# EasyEDA Pro project URADORRY-SUN1.2.eprj, schematic Main(1.2)

## Sheets
1 base: Create Date: 2024-06-10; Page Name: base; Project Name: URADORRY-SUN; Schematic Name: Main(1.2); Update Date: 2024-06-11; Add into BOM: yes; Company: 整数71の情報処理; Convert to PCB: yes; Drawed: 整数71
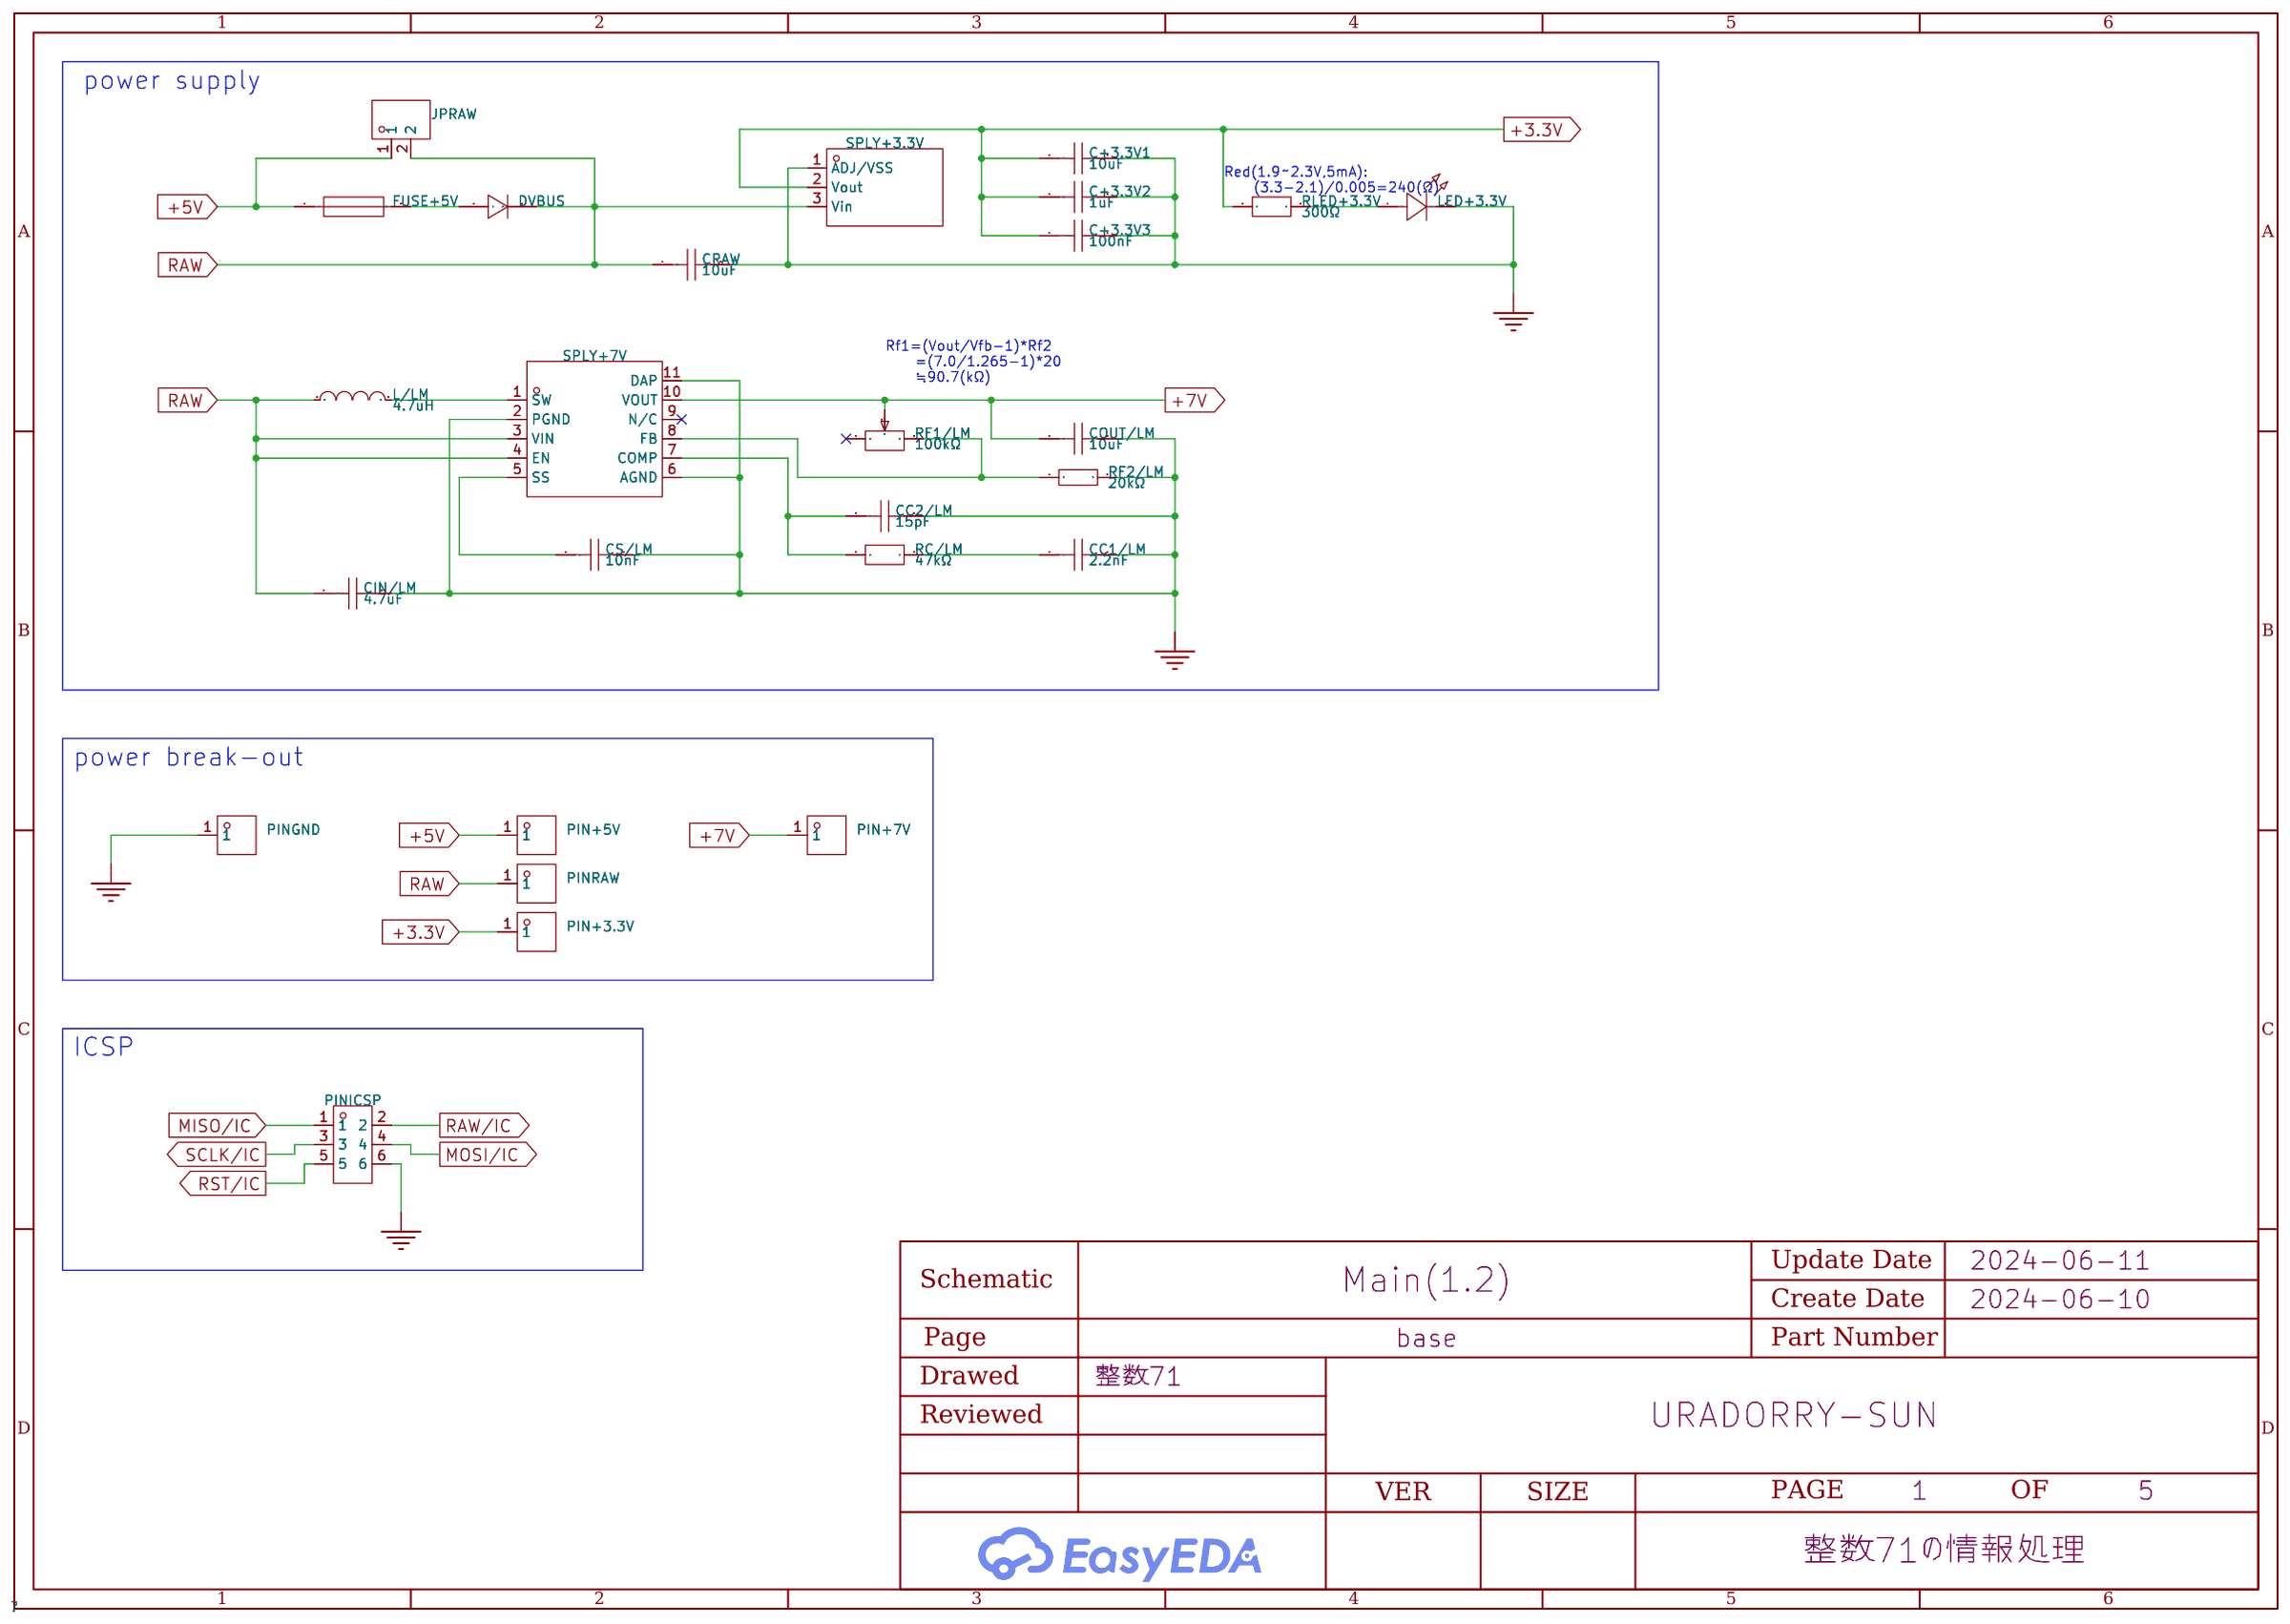
[diagram p2: base]
2 serial: Page Name: serial
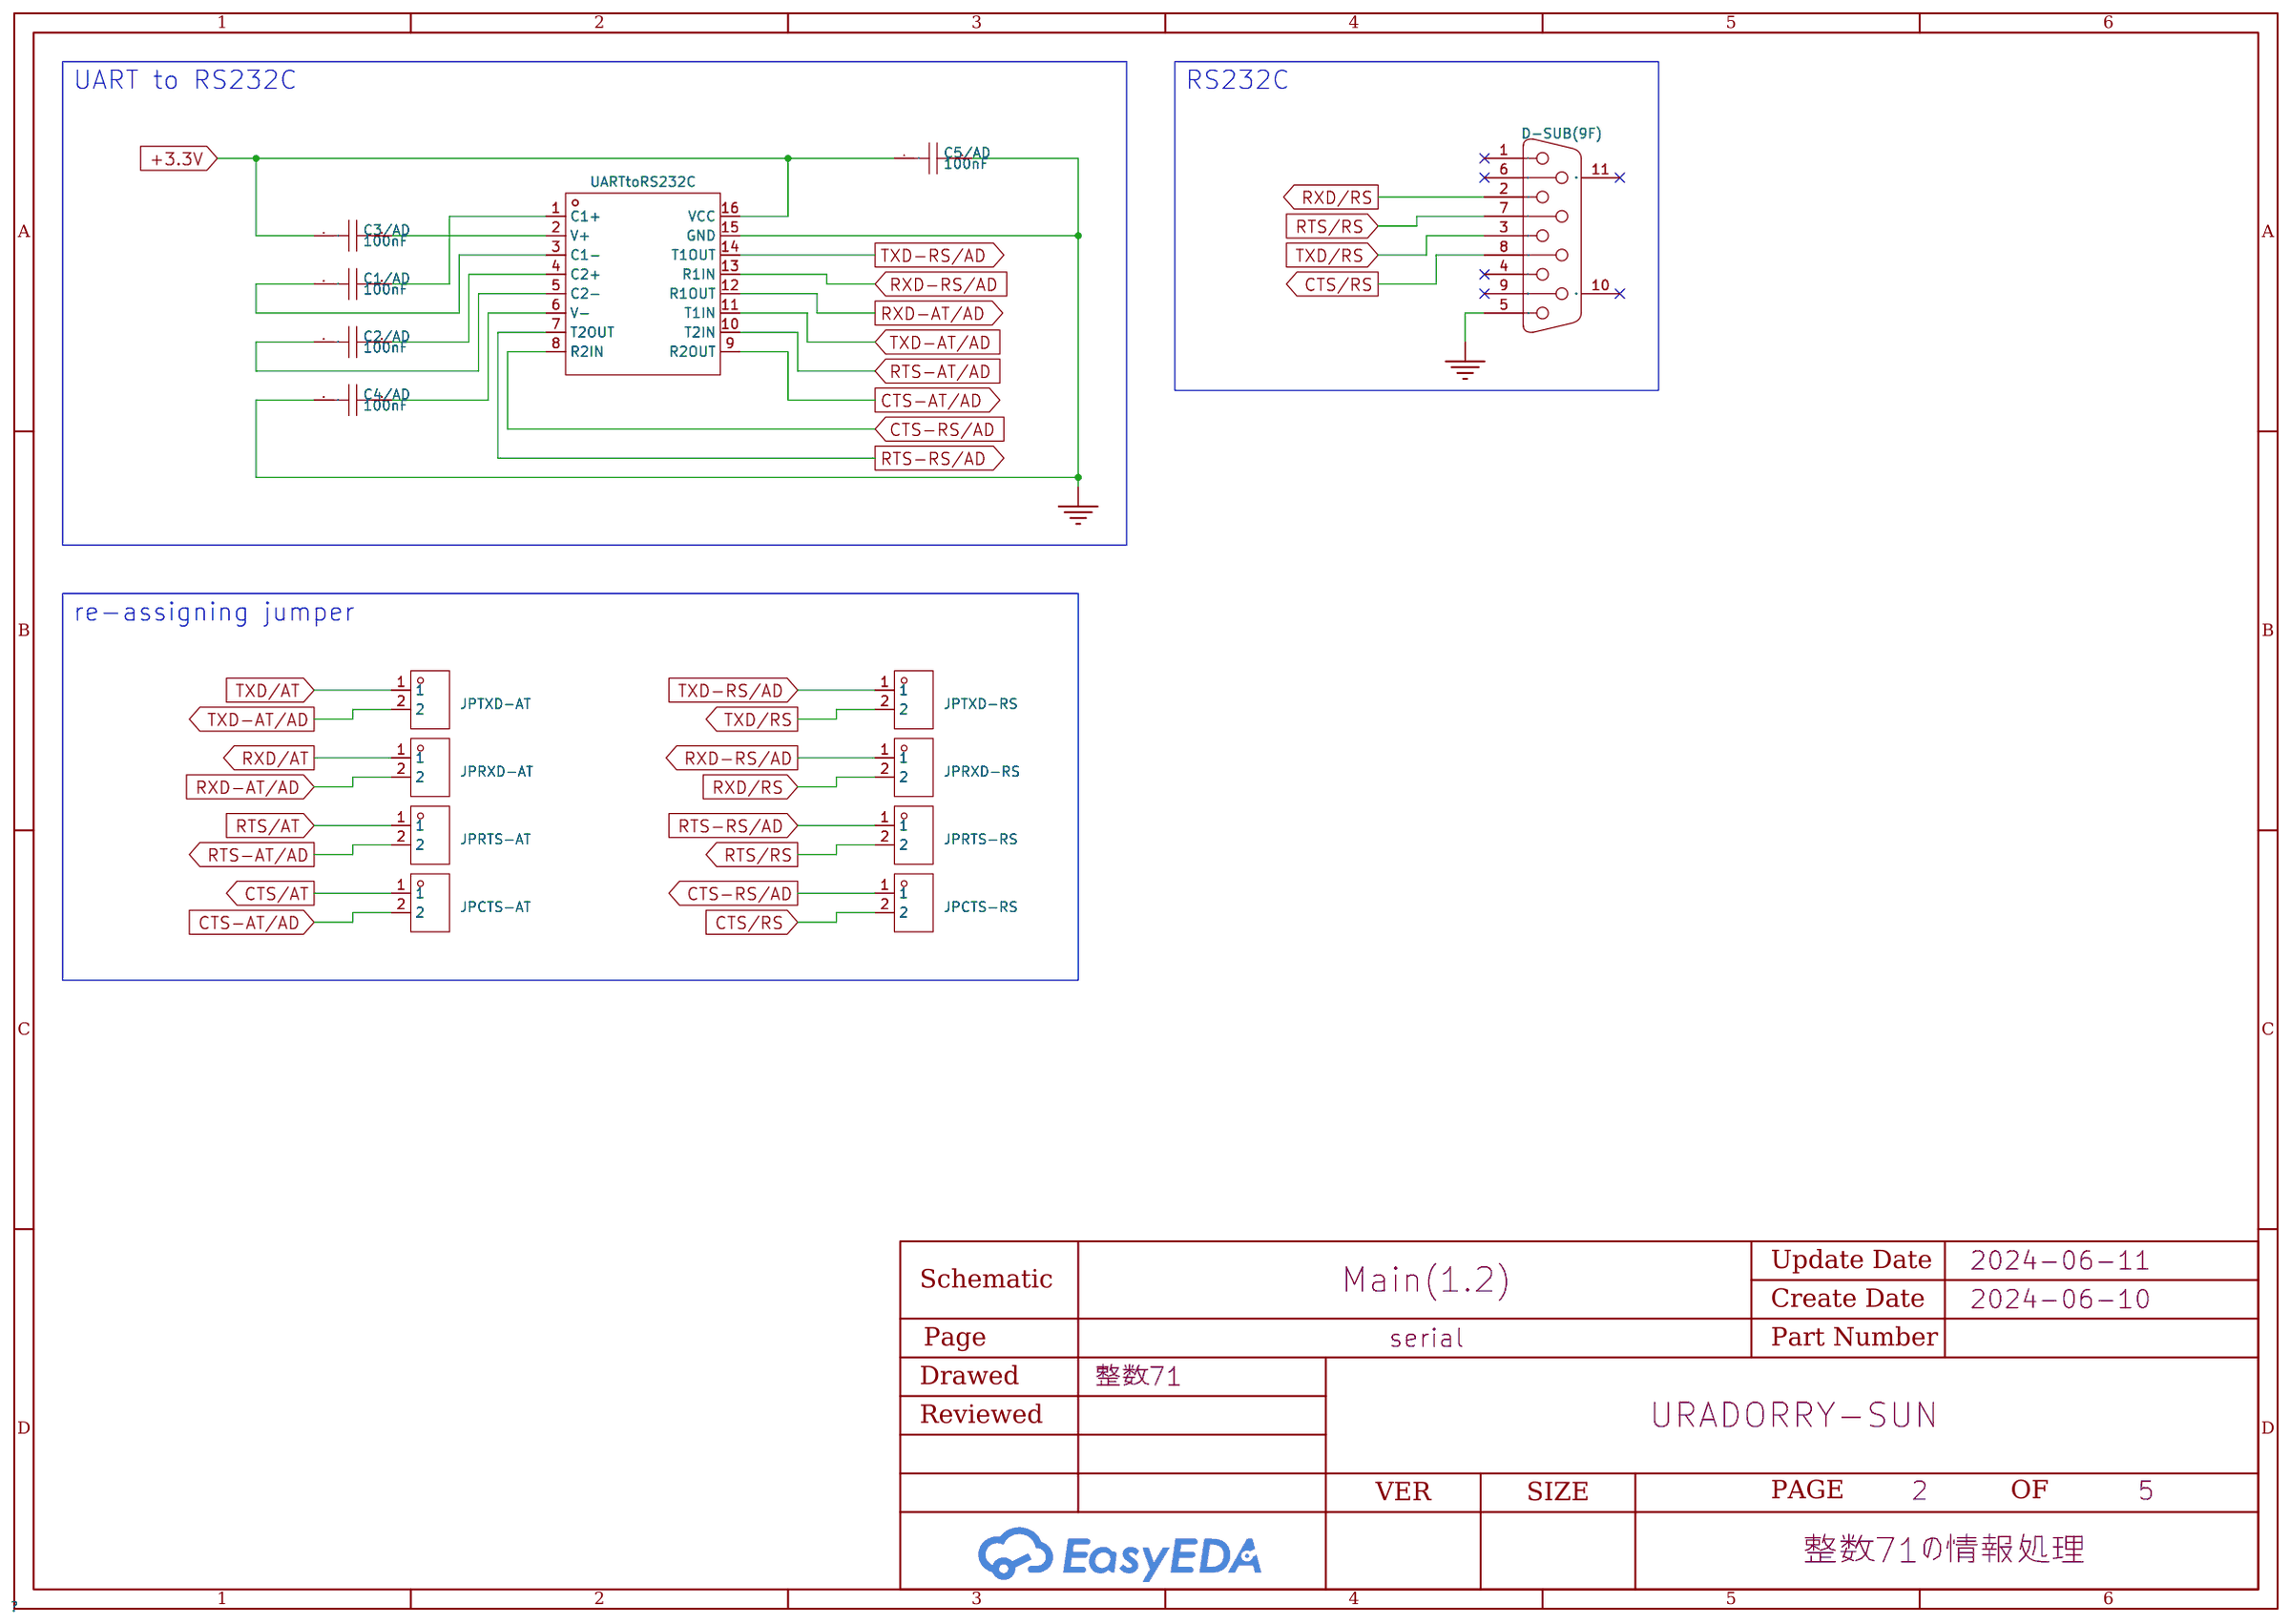
[diagram p3: serial]
3 switch: Page Name: switch
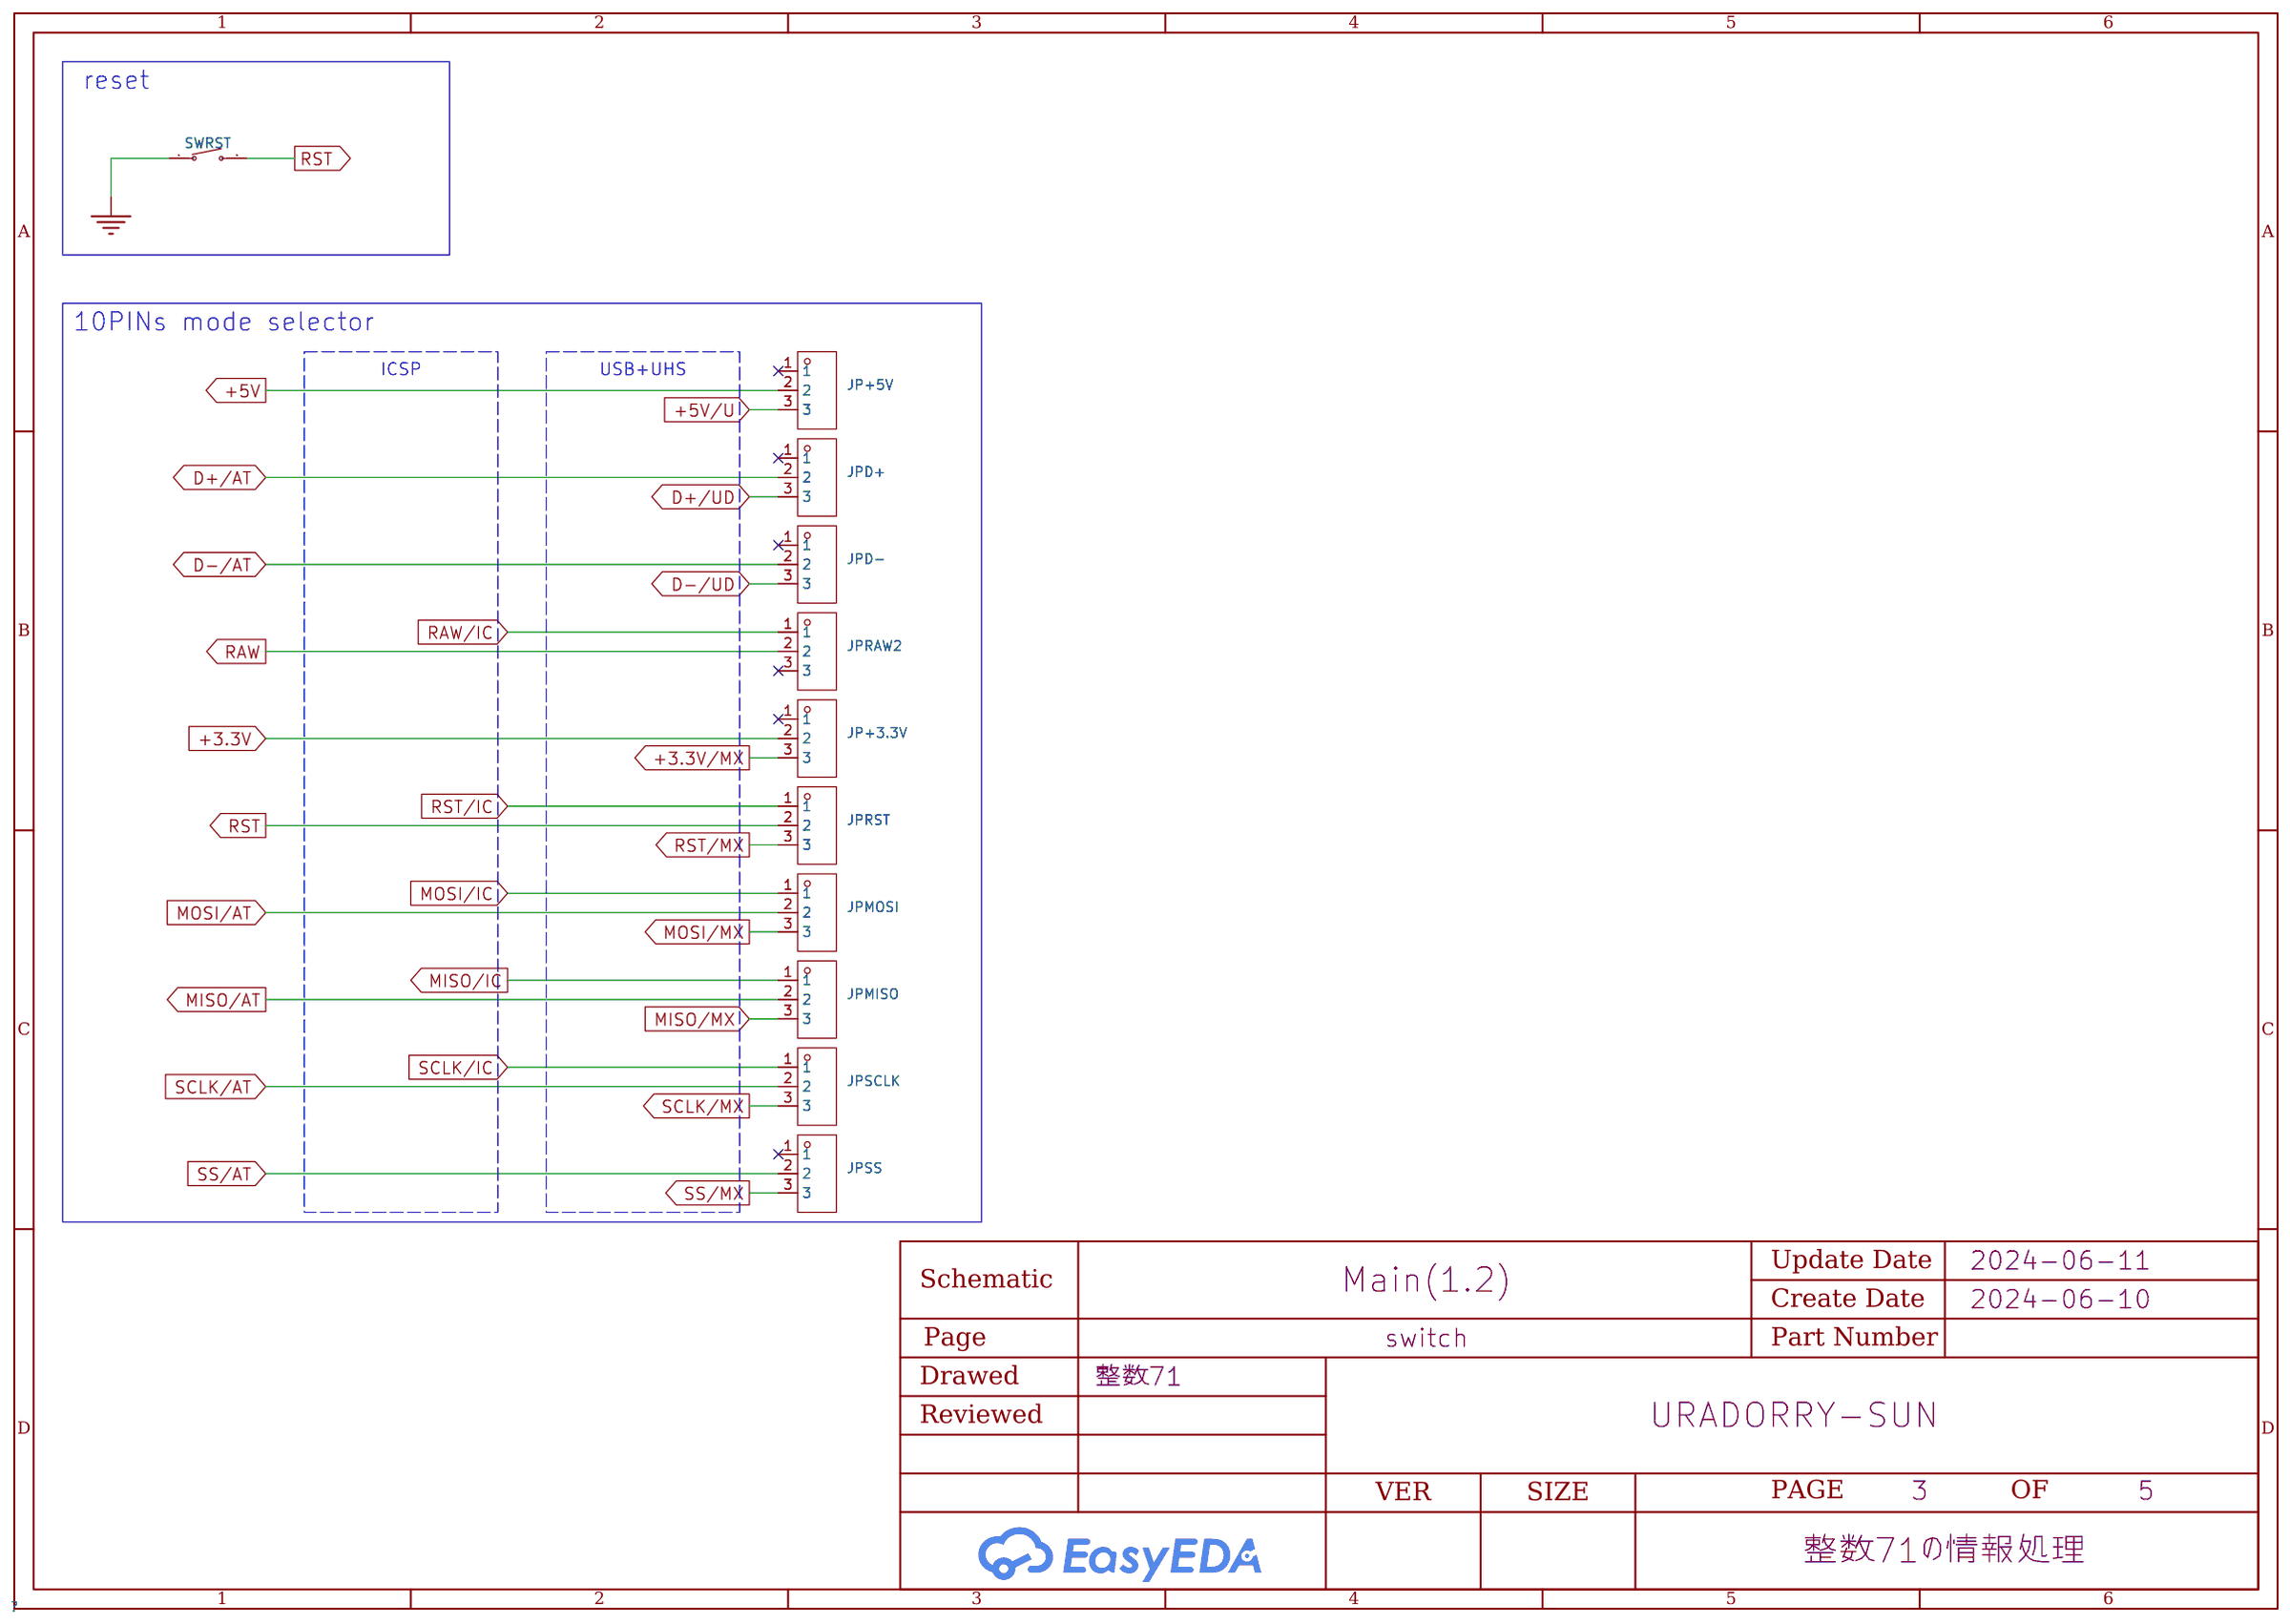
[diagram p4: switch]
4 Sub - ATmega32U4: Page Name: Sub - ATmega32U4